# EasyEDA Pro project ProPrj_Avaota A1 八核 AIoT 开发板_2024-05-03.epro, board PCB1 (continued)
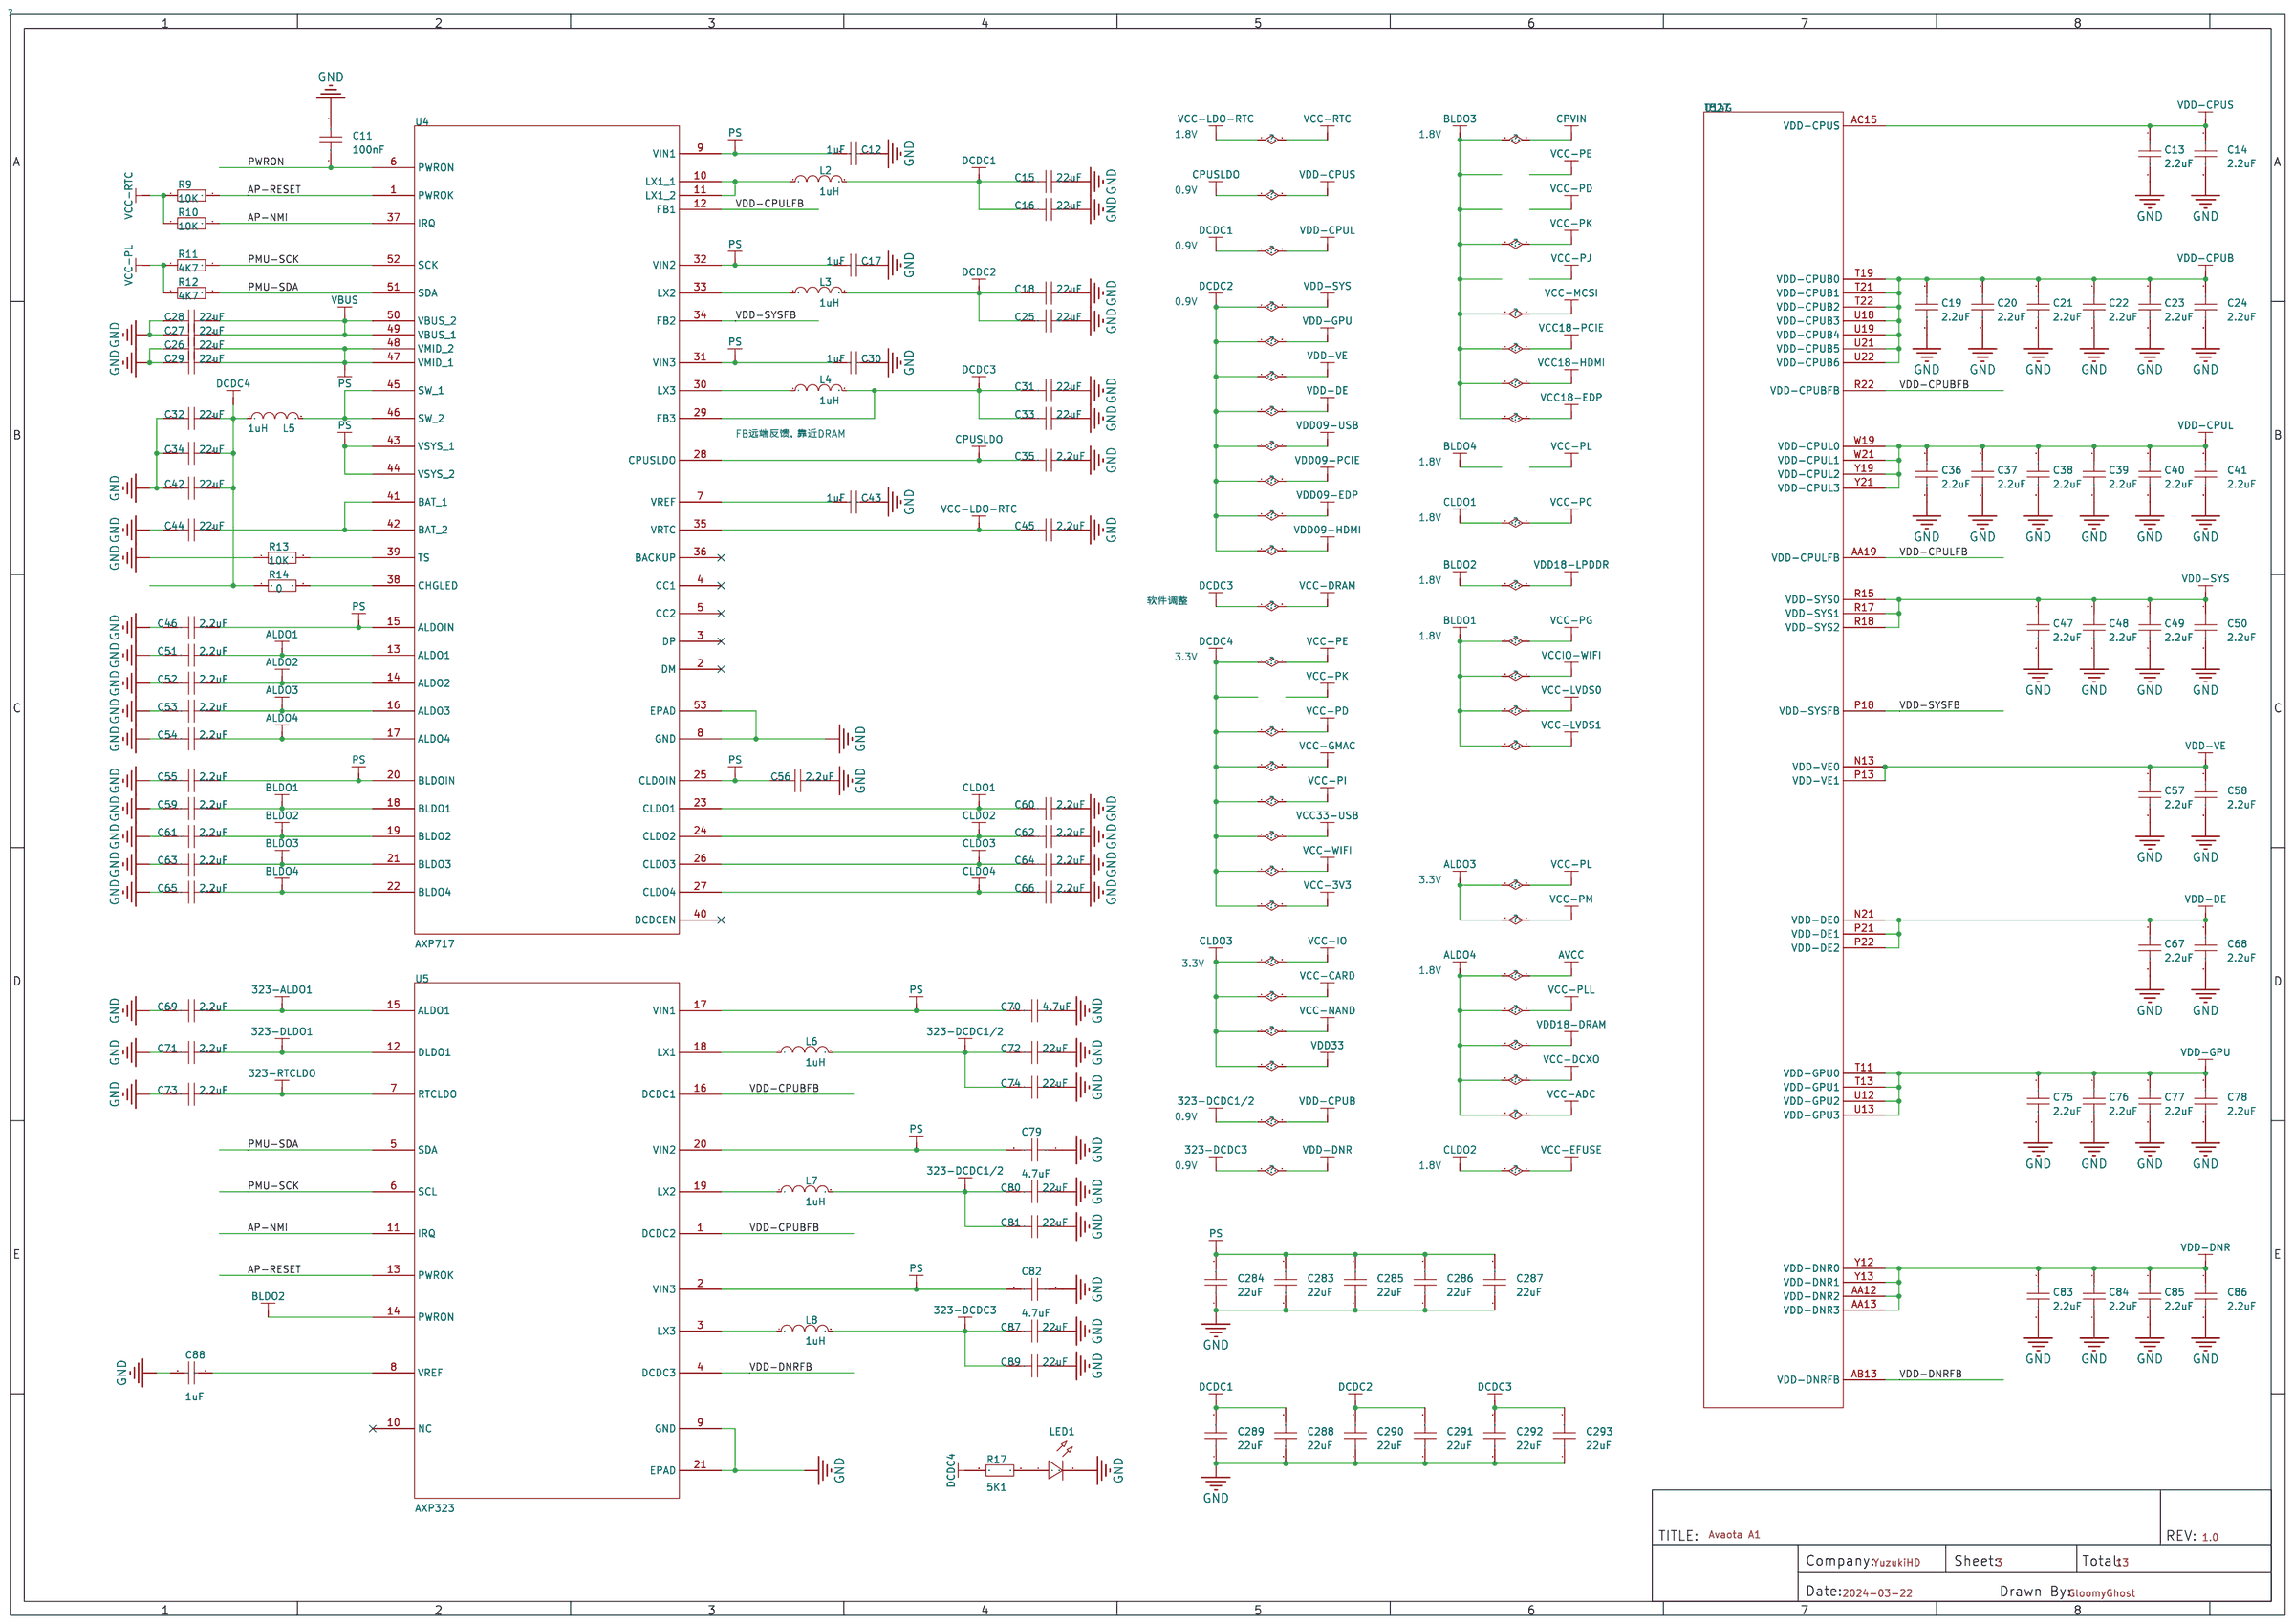
[diagram p0: POWER]
## Copper pours and planes (outline as drawn; the poured copper is in the pictures) (continued)
PS on Top Layer: 5.44,53.16 6.63,53.16 6.63,52.15 5.44,52.15
PS on 内层2: 6.71,55.99 13.01,55.99 14.76,54.25 14.76,49.1 19.25,44.6 19.25,41.15 18.44,40.34 15.19,40.34 10.21,45.31 5.21,45.31 3.15,47.37 3.15,54.64 4.23,55.72 6.43,55.72
$1N3706 on Top Layer: 9.37,49.23 10.54,49.23 10.54,47.47 9.37,47.47
$1N3718 on Top Layer: 7.68,56.45 8.85,56.45 8.85,54.45 7.68,54.45
$1N3723 on Top Layer: 9.14,56 10.31,56 10.31,54.45 9.14,54.45
$1N4773 on Top Layer: 4.47,54.81 6.04,54.81 6.04,53.33 4.47,53.33
$1N4992 on Top Layer: 2.89,52.38 6.06,52.38 6.06,50.85 2.89,50.85
$1N6251 on Top Layer: 17.3,43.19 19.89,43.19 19.89,40.77 17.3,40.77
$1N6517 on Top Layer: 17.3,45.21 19.89,45.21 19.89,43.08 17.3,43.08
$1N6728 on Top Layer: 15.88,46.96 17.88,46.96 17.88,44.07 15.88,44.07
$12N612 on Top Layer: 14.53,19.1 19.51,19.1 19.51,8.76 14.53,8.76
$12N1559 on Top Layer: 3.81,37.41 11.23,37.41 11.23,32.49 3.81,32.49
$12N1559 on Top Layer: 6.25,35.87 9.17,35.87 9.17,29.9 6.25,29.9

Small or netless copper shapes (teardrops, artwork), in the pictures only: 2 on Top Layer, 1 on Bottom Layer

## Text on the board
Bottom Silkscreen Layer: BIOS | v1.3 | RGB888/LVDS/MIPI DSI/JTAG / UART/IIC/I2S/SPI/PWM  MUX | TFCard/JTAG | OV13850 | Avaota A1
Top Silkscreen Layer: FAN | LPDDR4 | Allwinner T527 | eMMC | RESET | FEL | ON | RGB LED | 12VDC | USB | HDMI | DP | GPIO | ETH1 | ETH0 | CAN | AUDIO | OTG&D | IR | Avaota A1 | 拆拆我的
